# EasyEDA Pro project PR.eprj, schematic 新大符2.0 (continued)
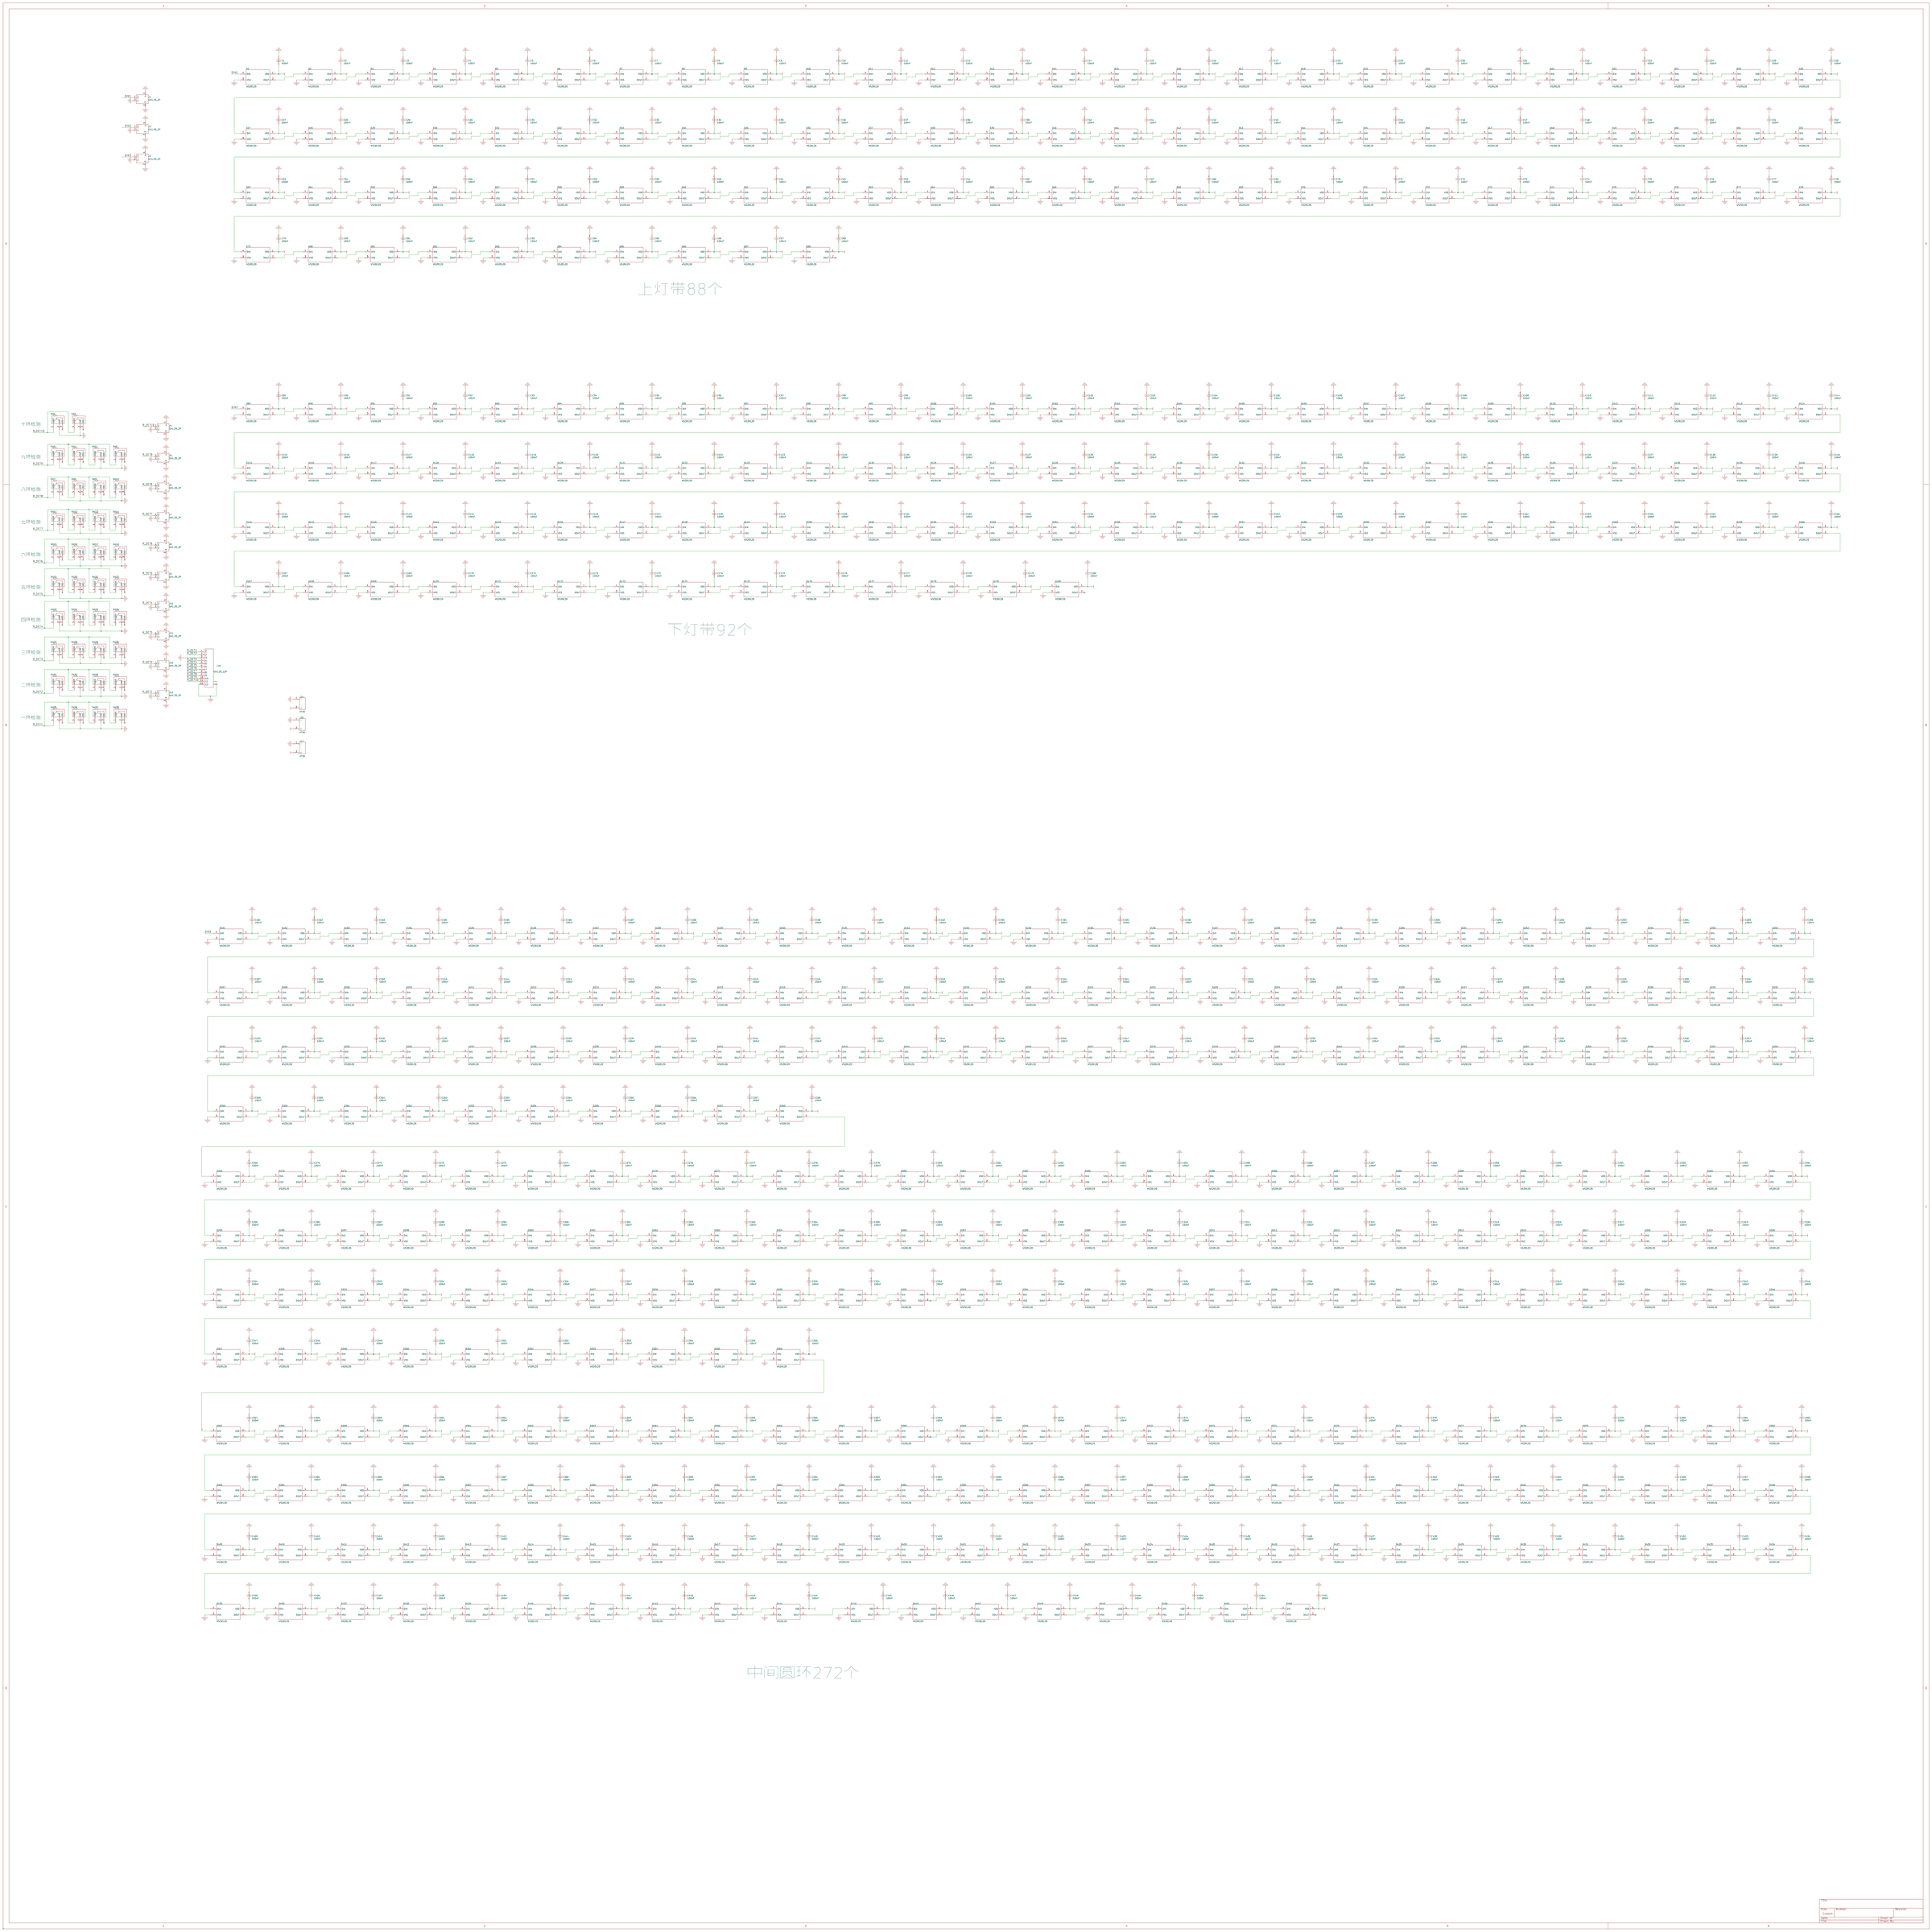
[diagram p0: schematic sheet]
## Parts (continued)
D187  *  [LED-SMD_4P-L5.0-W5.0-TL_WS2812B-B]
D188  *  [LED-SMD_4P-L5.0-W5.0-TL_WS2812B-B]
D189  *  [LED-SMD_4P-L5.0-W5.0-TL_WS2812B-B]
D190  *  [LED-SMD_4P-L5.0-W5.0-TL_WS2812B-B]
D191  *  [LED-SMD_4P-L5.0-W5.0-TL_WS2812B-B]
D192  *  [LED-SMD_4P-L5.0-W5.0-TL_WS2812B-B]
D193  *  [LED-SMD_4P-L5.0-W5.0-TL_WS2812B-B]
D194  *  [LED-SMD_4P-L5.0-W5.0-TL_WS2812B-B]
D195  *  [LED-SMD_4P-L5.0-W5.0-TL_WS2812B-B]
D196  *  [LED-SMD_4P-L5.0-W5.0-TL_WS2812B-B]
D197  *  [LED-SMD_4P-L5.0-W5.0-TL_WS2812B-B]
D198  *  [LED-SMD_4P-L5.0-W5.0-TL_WS2812B-B]
D199  *  [LED-SMD_4P-L5.0-W5.0-TL_WS2812B-B]
D200  *  [LED-SMD_4P-L5.0-W5.0-TL_WS2812B-B]
D201  *  [LED-SMD_4P-L5.0-W5.0-TL_WS2812B-B]
D202  *  [LED-SMD_4P-L5.0-W5.0-TL_WS2812B-B]
D203  *  [LED-SMD_4P-L5.0-W5.0-TL_WS2812B-B]
D204  *  [LED-SMD_4P-L5.0-W5.0-TL_WS2812B-B]
D205  *  [LED-SMD_4P-L5.0-W5.0-TL_WS2812B-B]
D206  *  [LED-SMD_4P-L5.0-W5.0-TL_WS2812B-B]
D207  *  [LED-SMD_4P-L5.0-W5.0-TL_WS2812B-B]
D208  *  [LED-SMD_4P-L5.0-W5.0-TL_WS2812B-B]
D209  *  [LED-SMD_4P-L5.0-W5.0-TL_WS2812B-B]
D210  *  [LED-SMD_4P-L5.0-W5.0-TL_WS2812B-B]
D211  *  [LED-SMD_4P-L5.0-W5.0-TL_WS2812B-B]
D212  *  [LED-SMD_4P-L5.0-W5.0-TL_WS2812B-B]
D213  *  [LED-SMD_4P-L5.0-W5.0-TL_WS2812B-B]
D214  *  [LED-SMD_4P-L5.0-W5.0-TL_WS2812B-B]
D215  *  [LED-SMD_4P-L5.0-W5.0-TL_WS2812B-B]
D216  *  [LED-SMD_4P-L5.0-W5.0-TL_WS2812B-B]
D217  *  [LED-SMD_4P-L5.0-W5.0-TL_WS2812B-B]
D218  *  [LED-SMD_4P-L5.0-W5.0-TL_WS2812B-B]
D219  *  [LED-SMD_4P-L5.0-W5.0-TL_WS2812B-B]
D220  *  [LED-SMD_4P-L5.0-W5.0-TL_WS2812B-B]
D221  *  [LED-SMD_4P-L5.0-W5.0-TL_WS2812B-B]
D222  *  [LED-SMD_4P-L5.0-W5.0-TL_WS2812B-B]
D223  *  [LED-SMD_4P-L5.0-W5.0-TL_WS2812B-B]
D224  *  [LED-SMD_4P-L5.0-W5.0-TL_WS2812B-B]
D225  *  [LED-SMD_4P-L5.0-W5.0-TL_WS2812B-B]
D226  *  [LED-SMD_4P-L5.0-W5.0-TL_WS2812B-B]
D227  *  [LED-SMD_4P-L5.0-W5.0-TL_WS2812B-B]
D228  *  [LED-SMD_4P-L5.0-W5.0-TL_WS2812B-B]
D229  *  [LED-SMD_4P-L5.0-W5.0-TL_WS2812B-B]
D230  *  [LED-SMD_4P-L5.0-W5.0-TL_WS2812B-B]
D231  *  [LED-SMD_4P-L5.0-W5.0-TL_WS2812B-B]
D232  *  [LED-SMD_4P-L5.0-W5.0-TL_WS2812B-B]
D233  *  [LED-SMD_4P-L5.0-W5.0-TL_WS2812B-B]
D234  *  [LED-SMD_4P-L5.0-W5.0-TL_WS2812B-B]
D235  *  [LED-SMD_4P-L5.0-W5.0-TL_WS2812B-B]
D236  *  [LED-SMD_4P-L5.0-W5.0-TL_WS2812B-B]
D237  *  [LED-SMD_4P-L5.0-W5.0-TL_WS2812B-B]
D238  *  [LED-SMD_4P-L5.0-W5.0-TL_WS2812B-B]
D239  *  [LED-SMD_4P-L5.0-W5.0-TL_WS2812B-B]
D240  *  [LED-SMD_4P-L5.0-W5.0-TL_WS2812B-B]
D241  *  [LED-SMD_4P-L5.0-W5.0-TL_WS2812B-B]
D242  *  [LED-SMD_4P-L5.0-W5.0-TL_WS2812B-B]
D243  *  [LED-SMD_4P-L5.0-W5.0-TL_WS2812B-B]
D244  *  [LED-SMD_4P-L5.0-W5.0-TL_WS2812B-B]
D245  *  [LED-SMD_4P-L5.0-W5.0-TL_WS2812B-B]
D246  *  [LED-SMD_4P-L5.0-W5.0-TL_WS2812B-B]
D247  *  [LED-SMD_4P-L5.0-W5.0-TL_WS2812B-B]
D248  *  [LED-SMD_4P-L5.0-W5.0-TL_WS2812B-B]
D249  *  [LED-SMD_4P-L5.0-W5.0-TL_WS2812B-B]
D250  *  [LED-SMD_4P-L5.0-W5.0-TL_WS2812B-B]
D251  *  [LED-SMD_4P-L5.0-W5.0-TL_WS2812B-B]
D252  *  [LED-SMD_4P-L5.0-W5.0-TL_WS2812B-B]
D253  *  [LED-SMD_4P-L5.0-W5.0-TL_WS2812B-B]
D254  *  [LED-SMD_4P-L5.0-W5.0-TL_WS2812B-B]
D255  *  [LED-SMD_4P-L5.0-W5.0-TL_WS2812B-B]
D256  *  [LED-SMD_4P-L5.0-W5.0-TL_WS2812B-B]
D257  *  [LED-SMD_4P-L5.0-W5.0-TL_WS2812B-B]
D258  *  [LED-SMD_4P-L5.0-W5.0-TL_WS2812B-B]
D259  *  [LED-SMD_4P-L5.0-W5.0-TL_WS2812B-B]
D260  *  [LED-SMD_4P-L5.0-W5.0-TL_WS2812B-B]
D261  *  [LED-SMD_4P-L5.0-W5.0-TL_WS2812B-B]
D262  *  [LED-SMD_4P-L5.0-W5.0-TL_WS2812B-B]
D263  *  [LED-SMD_4P-L5.0-W5.0-TL_WS2812B-B]
D264  *  [LED-SMD_4P-L5.0-W5.0-TL_WS2812B-B]
D265  *  [LED-SMD_4P-L5.0-W5.0-TL_WS2812B-B]
D266  *  [LED-SMD_4P-L5.0-W5.0-TL_WS2812B-B]
D267  *  [LED-SMD_4P-L5.0-W5.0-TL_WS2812B-B]
D268  *  [LED-SMD_4P-L5.0-W5.0-TL_WS2812B-B]
D269  *  [LED-SMD_4P-L5.0-W5.0-TL_WS2812B-B]
D270  *  [LED-SMD_4P-L5.0-W5.0-TL_WS2812B-B]
D271  *  [LED-SMD_4P-L5.0-W5.0-TL_WS2812B-B]
D272  *  [LED-SMD_4P-L5.0-W5.0-TL_WS2812B-B]
D273  *  [LED-SMD_4P-L5.0-W5.0-TL_WS2812B-B]
D274  *  [LED-SMD_4P-L5.0-W5.0-TL_WS2812B-B]
D275  *  [LED-SMD_4P-L5.0-W5.0-TL_WS2812B-B]
D276  *  [LED-SMD_4P-L5.0-W5.0-TL_WS2812B-B]
D277  *  [LED-SMD_4P-L5.0-W5.0-TL_WS2812B-B]
D278  *  [LED-SMD_4P-L5.0-W5.0-TL_WS2812B-B]
D279  *  [LED-SMD_4P-L5.0-W5.0-TL_WS2812B-B]
D280  *  [LED-SMD_4P-L5.0-W5.0-TL_WS2812B-B]
D281  *  [LED-SMD_4P-L5.0-W5.0-TL_WS2812B-B]
D282  *  [LED-SMD_4P-L5.0-W5.0-TL_WS2812B-B]
D283  *  [LED-SMD_4P-L5.0-W5.0-TL_WS2812B-B]
D284  *  [LED-SMD_4P-L5.0-W5.0-TL_WS2812B-B]
D285  *  [LED-SMD_4P-L5.0-W5.0-TL_WS2812B-B]
D286  *  [LED-SMD_4P-L5.0-W5.0-TL_WS2812B-B]
D287  *  [LED-SMD_4P-L5.0-W5.0-TL_WS2812B-B]
D288  *  [LED-SMD_4P-L5.0-W5.0-TL_WS2812B-B]
D289  *  [LED-SMD_4P-L5.0-W5.0-TL_WS2812B-B]
D290  *  [LED-SMD_4P-L5.0-W5.0-TL_WS2812B-B]
D291  *  [LED-SMD_4P-L5.0-W5.0-TL_WS2812B-B]
D292  *  [LED-SMD_4P-L5.0-W5.0-TL_WS2812B-B]
D293  *  [LED-SMD_4P-L5.0-W5.0-TL_WS2812B-B]
D294  *  [LED-SMD_4P-L5.0-W5.0-TL_WS2812B-B]
D295  *  [LED-SMD_4P-L5.0-W5.0-TL_WS2812B-B]
D296  *  [LED-SMD_4P-L5.0-W5.0-TL_WS2812B-B]
D297  *  [LED-SMD_4P-L5.0-W5.0-TL_WS2812B-B]
D298  *  [LED-SMD_4P-L5.0-W5.0-TL_WS2812B-B]
D299  *  [LED-SMD_4P-L5.0-W5.0-TL_WS2812B-B]
D300  *  [LED-SMD_4P-L5.0-W5.0-TL_WS2812B-B]
D301  *  [LED-SMD_4P-L5.0-W5.0-TL_WS2812B-B]
D302  *  [LED-SMD_4P-L5.0-W5.0-TL_WS2812B-B]
D303  *  [LED-SMD_4P-L5.0-W5.0-TL_WS2812B-B]
D304  *  [LED-SMD_4P-L5.0-W5.0-TL_WS2812B-B]
D305  *  [LED-SMD_4P-L5.0-W5.0-TL_WS2812B-B]
D306  *  [LED-SMD_4P-L5.0-W5.0-TL_WS2812B-B]
D307  *  [LED-SMD_4P-L5.0-W5.0-TL_WS2812B-B]
D308  *  [LED-SMD_4P-L5.0-W5.0-TL_WS2812B-B]
D309  *  [LED-SMD_4P-L5.0-W5.0-TL_WS2812B-B]
D310  *  [LED-SMD_4P-L5.0-W5.0-TL_WS2812B-B]
D311  *  [LED-SMD_4P-L5.0-W5.0-TL_WS2812B-B]
D312  *  [LED-SMD_4P-L5.0-W5.0-TL_WS2812B-B]
D313  *  [LED-SMD_4P-L5.0-W5.0-TL_WS2812B-B]
D314  *  [LED-SMD_4P-L5.0-W5.0-TL_WS2812B-B]
D315  *  [LED-SMD_4P-L5.0-W5.0-TL_WS2812B-B]
D316  *  [LED-SMD_4P-L5.0-W5.0-TL_WS2812B-B]
D317  *  [LED-SMD_4P-L5.0-W5.0-TL_WS2812B-B]
D318  *  [LED-SMD_4P-L5.0-W5.0-TL_WS2812B-B]
D319  *  [LED-SMD_4P-L5.0-W5.0-TL_WS2812B-B]
D320  *  [LED-SMD_4P-L5.0-W5.0-TL_WS2812B-B]
D321  *  [LED-SMD_4P-L5.0-W5.0-TL_WS2812B-B]
D322  *  [LED-SMD_4P-L5.0-W5.0-TL_WS2812B-B]
D323  *  [LED-SMD_4P-L5.0-W5.0-TL_WS2812B-B]
D324  *  [LED-SMD_4P-L5.0-W5.0-TL_WS2812B-B]
D325  *  [LED-SMD_4P-L5.0-W5.0-TL_WS2812B-B]
D326  *  [LED-SMD_4P-L5.0-W5.0-TL_WS2812B-B]
D327  *  [LED-SMD_4P-L5.0-W5.0-TL_WS2812B-B]
D328  *  [LED-SMD_4P-L5.0-W5.0-TL_WS2812B-B]
D329  *  [LED-SMD_4P-L5.0-W5.0-TL_WS2812B-B]
D330  *  [LED-SMD_4P-L5.0-W5.0-TL_WS2812B-B]
D331  *  [LED-SMD_4P-L5.0-W5.0-TL_WS2812B-B]
D332  *  [LED-SMD_4P-L5.0-W5.0-TL_WS2812B-B]
D333  *  [LED-SMD_4P-L5.0-W5.0-TL_WS2812B-B]
D334  *  [LED-SMD_4P-L5.0-W5.0-TL_WS2812B-B]
D335  *  [LED-SMD_4P-L5.0-W5.0-TL_WS2812B-B]
D336  *  [LED-SMD_4P-L5.0-W5.0-TL_WS2812B-B]
D337  *  [LED-SMD_4P-L5.0-W5.0-TL_WS2812B-B]
D338  *  [LED-SMD_4P-L5.0-W5.0-TL_WS2812B-B]
D339  *  [LED-SMD_4P-L5.0-W5.0-TL_WS2812B-B]
D340  *  [LED-SMD_4P-L5.0-W5.0-TL_WS2812B-B]
D341  *  [LED-SMD_4P-L5.0-W5.0-TL_WS2812B-B]
D342  *  [LED-SMD_4P-L5.0-W5.0-TL_WS2812B-B]
D343  *  [LED-SMD_4P-L5.0-W5.0-TL_WS2812B-B]
D344  *  [LED-SMD_4P-L5.0-W5.0-TL_WS2812B-B]
D345  *  [LED-SMD_4P-L5.0-W5.0-TL_WS2812B-B]
D346  *  [LED-SMD_4P-L5.0-W5.0-TL_WS2812B-B]
D347  *  [LED-SMD_4P-L5.0-W5.0-TL_WS2812B-B]
D348  *  [LED-SMD_4P-L5.0-W5.0-TL_WS2812B-B]
D349  *  [LED-SMD_4P-L5.0-W5.0-TL_WS2812B-B]
D350  *  [LED-SMD_4P-L5.0-W5.0-TL_WS2812B-B]
D351  *  [LED-SMD_4P-L5.0-W5.0-TL_WS2812B-B]
D352  *  [LED-SMD_4P-L5.0-W5.0-TL_WS2812B-B]
D353  *  [LED-SMD_4P-L5.0-W5.0-TL_WS2812B-B]
D354  *  [LED-SMD_4P-L5.0-W5.0-TL_WS2812B-B]
D355  *  [LED-SMD_4P-L5.0-W5.0-TL_WS2812B-B]
D356  *  [LED-SMD_4P-L5.0-W5.0-TL_WS2812B-B]
D357  *  [LED-SMD_4P-L5.0-W5.0-TL_WS2812B-B]
D358  *  [LED-SMD_4P-L5.0-W5.0-TL_WS2812B-B]
D359  *  [LED-SMD_4P-L5.0-W5.0-TL_WS2812B-B]
D360  *  [LED-SMD_4P-L5.0-W5.0-TL_WS2812B-B]
D361  *  [LED-SMD_4P-L5.0-W5.0-TL_WS2812B-B]
D362  *  [LED-SMD_4P-L5.0-W5.0-TL_WS2812B-B]
D363  *  [LED-SMD_4P-L5.0-W5.0-TL_WS2812B-B]
D364  *  [LED-SMD_4P-L5.0-W5.0-TL_WS2812B-B]
D365  *  [LED-SMD_4P-L5.0-W5.0-TL_WS2812B-B]
D366  *  [LED-SMD_4P-L5.0-W5.0-TL_WS2812B-B]
D367  *  [LED-SMD_4P-L5.0-W5.0-TL_WS2812B-B]
D368  *  [LED-SMD_4P-L5.0-W5.0-TL_WS2812B-B]
D369  *  [LED-SMD_4P-L5.0-W5.0-TL_WS2812B-B]
D370  *  [LED-SMD_4P-L5.0-W5.0-TL_WS2812B-B]
D371  *  [LED-SMD_4P-L5.0-W5.0-TL_WS2812B-B]
D372  *  [LED-SMD_4P-L5.0-W5.0-TL_WS2812B-B]
D373  *  [LED-SMD_4P-L5.0-W5.0-TL_WS2812B-B]
D374  *  [LED-SMD_4P-L5.0-W5.0-TL_WS2812B-B]
D375  *  [LED-SMD_4P-L5.0-W5.0-TL_WS2812B-B]
D376  *  [LED-SMD_4P-L5.0-W5.0-TL_WS2812B-B]
D377  *  [LED-SMD_4P-L5.0-W5.0-TL_WS2812B-B]
D378  *  [LED-SMD_4P-L5.0-W5.0-TL_WS2812B-B]
D379  *  [LED-SMD_4P-L5.0-W5.0-TL_WS2812B-B]
D380  *  [LED-SMD_4P-L5.0-W5.0-TL_WS2812B-B]
D381  *  [LED-SMD_4P-L5.0-W5.0-TL_WS2812B-B]
D382  *  [LED-SMD_4P-L5.0-W5.0-TL_WS2812B-B]
D383  *  [LED-SMD_4P-L5.0-W5.0-TL_WS2812B-B]
D384  *  [LED-SMD_4P-L5.0-W5.0-TL_WS2812B-B]
D385  *  [LED-SMD_4P-L5.0-W5.0-TL_WS2812B-B]
D386  *  [LED-SMD_4P-L5.0-W5.0-TL_WS2812B-B]
D387  *  [LED-SMD_4P-L5.0-W5.0-TL_WS2812B-B]
D388  *  [LED-SMD_4P-L5.0-W5.0-TL_WS2812B-B]
D389  *  [LED-SMD_4P-L5.0-W5.0-TL_WS2812B-B]
D390  *  [LED-SMD_4P-L5.0-W5.0-TL_WS2812B-B]
D391  *  [LED-SMD_4P-L5.0-W5.0-TL_WS2812B-B]
D392  *  [LED-SMD_4P-L5.0-W5.0-TL_WS2812B-B]
D393  *  [LED-SMD_4P-L5.0-W5.0-TL_WS2812B-B]
D394  *  [LED-SMD_4P-L5.0-W5.0-TL_WS2812B-B]
D395  *  [LED-SMD_4P-L5.0-W5.0-TL_WS2812B-B]
D396  *  [LED-SMD_4P-L5.0-W5.0-TL_WS2812B-B]
D397  *  [LED-SMD_4P-L5.0-W5.0-TL_WS2812B-B]
D398  *  [LED-SMD_4P-L5.0-W5.0-TL_WS2812B-B]
D399  *  [LED-SMD_4P-L5.0-W5.0-TL_WS2812B-B]
D400  *  [LED-SMD_4P-L5.0-W5.0-TL_WS2812B-B]
D401  *  [LED-SMD_4P-L5.0-W5.0-TL_WS2812B-B]
D402  *  [LED-SMD_4P-L5.0-W5.0-TL_WS2812B-B]
D403  *  [LED-SMD_4P-L5.0-W5.0-TL_WS2812B-B]
D404  *  [LED-SMD_4P-L5.0-W5.0-TL_WS2812B-B]
D405  *  [LED-SMD_4P-L5.0-W5.0-TL_WS2812B-B]
D406  *  [LED-SMD_4P-L5.0-W5.0-TL_WS2812B-B]
D407  *  [LED-SMD_4P-L5.0-W5.0-TL_WS2812B-B]
D408  *  [LED-SMD_4P-L5.0-W5.0-TL_WS2812B-B]
D409  *  [LED-SMD_4P-L5.0-W5.0-TL_WS2812B-B]
D410  *  [LED-SMD_4P-L5.0-W5.0-TL_WS2812B-B]
D411  *  [LED-SMD_4P-L5.0-W5.0-TL_WS2812B-B]
D412  *  [LED-SMD_4P-L5.0-W5.0-TL_WS2812B-B]
D413  *  [LED-SMD_4P-L5.0-W5.0-TL_WS2812B-B]
D414  *  [LED-SMD_4P-L5.0-W5.0-TL_WS2812B-B]
D415  *  [LED-SMD_4P-L5.0-W5.0-TL_WS2812B-B]
D416  *  [LED-SMD_4P-L5.0-W5.0-TL_WS2812B-B]
D417  *  [LED-SMD_4P-L5.0-W5.0-TL_WS2812B-B]
D418  *  [LED-SMD_4P-L5.0-W5.0-TL_WS2812B-B]
D419  *  [LED-SMD_4P-L5.0-W5.0-TL_WS2812B-B]
D420  *  [LED-SMD_4P-L5.0-W5.0-TL_WS2812B-B]
D421  *  [LED-SMD_4P-L5.0-W5.0-TL_WS2812B-B]
D422  *  [LED-SMD_4P-L5.0-W5.0-TL_WS2812B-B]
D423  *  [LED-SMD_4P-L5.0-W5.0-TL_WS2812B-B]
D424  *  [LED-SMD_4P-L5.0-W5.0-TL_WS2812B-B]
D425  *  [LED-SMD_4P-L5.0-W5.0-TL_WS2812B-B]
D426  *  [LED-SMD_4P-L5.0-W5.0-TL_WS2812B-B]
D427  *  [LED-SMD_4P-L5.0-W5.0-TL_WS2812B-B]
D428  *  [LED-SMD_4P-L5.0-W5.0-TL_WS2812B-B]
D429  *  [LED-SMD_4P-L5.0-W5.0-TL_WS2812B-B]
D430  *  [LED-SMD_4P-L5.0-W5.0-TL_WS2812B-B]
D431  *  [LED-SMD_4P-L5.0-W5.0-TL_WS2812B-B]
D432  *  [LED-SMD_4P-L5.0-W5.0-TL_WS2812B-B]
D433  *  [LED-SMD_4P-L5.0-W5.0-TL_WS2812B-B]
D434  *  [LED-SMD_4P-L5.0-W5.0-TL_WS2812B-B]
D435  *  [LED-SMD_4P-L5.0-W5.0-TL_WS2812B-B]
D436  *  [LED-SMD_4P-L5.0-W5.0-TL_WS2812B-B]
D437  *  [LED-SMD_4P-L5.0-W5.0-TL_WS2812B-B]
D438  *  [LED-SMD_4P-L5.0-W5.0-TL_WS2812B-B]
D439  *  [LED-SMD_4P-L5.0-W5.0-TL_WS2812B-B]
D440  *  [LED-SMD_4P-L5.0-W5.0-TL_WS2812B-B]
D441  *  [LED-SMD_4P-L5.0-W5.0-TL_WS2812B-B]
D442  *  [LED-SMD_4P-L5.0-W5.0-TL_WS2812B-B]
D443  *  [LED-SMD_4P-L5.0-W5.0-TL_WS2812B-B]
D444  *  [LED-SMD_4P-L5.0-W5.0-TL_WS2812B-B]
D445  *  [LED-SMD_4P-L5.0-W5.0-TL_WS2812B-B]
D446  *  [LED-SMD_4P-L5.0-W5.0-TL_WS2812B-B]
D447  *  [LED-SMD_4P-L5.0-W5.0-TL_WS2812B-B]
D448  *  [LED-SMD_4P-L5.0-W5.0-TL_WS2812B-B]
D449  *  [LED-SMD_4P-L5.0-W5.0-TL_WS2812B-B]
D450  *  [LED-SMD_4P-L5.0-W5.0-TL_WS2812B-B]
D451  *  [LED-SMD_4P-L5.0-W5.0-TL_WS2812B-B]
D452  *  [LED-SMD_4P-L5.0-W5.0-TL_WS2812B-B]
J1  GH1.25_2P  [GH1.25-LS-2P]
J2  GH1.25_2P  [GH1.25-LS-2P]
J3  GH1.25_2P  [GH1.25-LS-2P]
J4  GH1.25_2P  [GH1.25-LS-2P]
J5  GH1.25_2P  [GH1.25-LS-2P]
J6  GH1.25_2P  [GH1.25-LS-2P]
J7  GH1.25_2P  [GH1.25-LS-2P]
J8  GH1.25_2P  [GH1.25-LS-2P]
J9  GH1.25_2P  [GH1.25-LS-2P]
J10  GH1.25_2P  [GH1.25-LS-2P]
J11  GH1.25_2P  [GH1.25-LS-2P]
J12  GH1.25_2P  [GH1.25-LS-2P]
J13  GH1.25_2P  [GH1.25-LS-2P]
J14  XT30  [XT30M]
J15  XT30  [XT30M]
J17  XT30  [XT30M]
J18  GH1.25_12P  [GH1.25_12P]
SW1  Microswitch  [SW-TH_MICROSWITCH]
SW2  Microswitch  [SW-TH_MICROSWITCH]
SW3  Microswitch  [SW-TH_MICROSWITCH]
SW4  Microswitch  [SW-TH_MICROSWITCH]
SW5  Microswitch  [SW-TH_MICROSWITCH]
SW6  Microswitch  [SW-TH_MICROSWITCH]
SW7  Microswitch  [SW-TH_MICROSWITCH]
SW8  Microswitch  [SW-TH_MICROSWITCH]
SW9  Microswitch  [SW-TH_MICROSWITCH]
SW10  Microswitch  [SW-TH_MICROSWITCH]
SW11  Microswitch  [SW-TH_MICROSWITCH]
SW12  Microswitch  [SW-TH_MICROSWITCH]
SW13  Microswitch  [SW-TH_MICROSWITCH]
SW14  Microswitch  [SW-TH_MICROSWITCH]
SW15  Microswitch  [SW-TH_MICROSWITCH]
SW16  Microswitch  [SW-TH_MICROSWITCH]
SW17  Microswitch  [SW-TH_MICROSWITCH]
SW18  Microswitch  [SW-TH_MICROSWITCH]
SW19  Microswitch  [SW-TH_MICROSWITCH]
SW20  Microswitch  [SW-TH_MICROSWITCH]
SW21  Microswitch  [SW-TH_MICROSWITCH]
SW22  Microswitch  [SW-TH_MICROSWITCH]
SW23  Microswitch  [SW-TH_MICROSWITCH]
SW24  Microswitch  [SW-TH_MICROSWITCH]
SW25  Microswitch  [SW-TH_MICROSWITCH]
SW26  Microswitch  [SW-TH_MICROSWITCH]
SW27  Microswitch  [SW-TH_MICROSWITCH]
SW28  Microswitch  [SW-TH_MICROSWITCH]
SW29  Microswitch  [SW-TH_MICROSWITCH]
SW30  Microswitch  [SW-TH_MICROSWITCH]
SW31  Microswitch  [SW-TH_MICROSWITCH]
SW32  Microswitch  [SW-TH_MICROSWITCH]
SW33  Microswitch  [SW-TH_MICROSWITCH]
SW34  Microswitch  [SW-TH_MICROSWITCH]
SW35  Microswitch  [SW-TH_MICROSWITCH]
SW36  Microswitch  [SW-TH_MICROSWITCH]
SW37  Microswitch  [SW-TH_MICROSWITCH]
SW38  Microswitch  [SW-TH_MICROSWITCH]

## Library data of the parts
C1-C452 = 100nF: Capacitor; Supplier: LCSC; Manufacturer: SEIKO; Manufacturer Part: XH414HG-IV01E; Supplier Part: C38065; Library Name: LIN_Library
D1-D452 = WS2812B: Intelligent control LED integrated light source; Availability: Unavailable; Price: None; MP: WS2812B-B; Library Name: LIN_Library
J1-J13 = GH1.25_2P: Connector; Origin Footprint 2: GH1.25-WS-2P; Library Name: LIN_Library
J14 J15 J17 = XT30: 电池接头连接器; Origin Footprint 2: XT30F; Library Name: LIN_Library
J18 = GH1.25_12P: LCSC Part Name: 立式贴片 镀锡12P; Supplier Part: C272988; Manufacturer: CJT(长江连接器); Manufacturer Part: A1257WV-S-12P; Supplier Footprint: SMD,P=1.25mm; JLCPCB Part Class: Extended Part; Datasheet: https://atta.szlcsc.com/upload/public/pdf/source/20181008/C272988_212BDFCFF0BBDA51EDF8FB81D3CF3687.pdf; Supplier: LCSC; Reference Series: GH; Pitch: 1.25mm; Pins Structure: 1x12P; Number of Rows: 1; Number of PINs Per Row: 12; Contact Material: 黄铜; Origin Footprint 2: CONN-SMD_A1257WV-S-12P; Design Item ID: A1257WV-S-12P
SW1-SW38 = Microswitch: 淘宝risym旗舰店（鼠标开关带弯柄1A 125V）; LCSC Part Name: SS-5GL111; Supplier Part: C5123513; Manufacturer: OMRON(欧姆龙); Manufacturer Part: SS-5GL111; Supplier Footprint: 插件; Datasheet: https://atta.szlcsc.com/upload/public/pdf/source/20220815/0B025EB52777D6B6F4567A2D38F1A354.pdf; Supplier: LCSC; Library Name: LIN_Library

## Nets
GND: C1.2 C2.2 C3.2 C4.2 C5.2 C6.2 C7.2 C8.2 C9.2 C10.2 C11.2 C12.2 C13.2 C14.2 C15.2 C16.2 C17.2 C18.2 C19.2 C20.2 C21.2 C22.2 C23.2 C24.2 C25.2 C26.2 C27.2 C28.2 C29.2 C30.2 C31.2 C32.2 C33.2 C34.2 C35.2 C36.2 C37.2 C38.2 C39.2 C40.2 C41.2 C42.2 C43.2 C44.2 C45.2 C46.2 C47.2 C48.2 C49.2 C50.2 C51.2 C52.2 C53.2 C54.2 C55.2 C56.2 C57.2 C58.2 C59.2 C60.2 C61.2 C62.2 C63.2 C64.2 C65.2 C66.2 C67.2 C68.2 C69.2 C70.2 C71.2 C72.2 C73.2 C74.2 C75.2 C76.2 C77.2 C78.2 C79.2 C80.2 C81.2 C82.2 C83.2 C84.2 C85.2 C86.2 C87.2 C88.2 C89.2 C90.2 C91.2 C92.2 C93.2 C94.2 C95.2 C96.2 C97.2 C98.2 C99.2 C100.2 C101.2 C102.2 C103.2 C104.2 C105.2 C106.2 C107.2 C108.2 C109.2 C110.2 C111.2 C112.2 C113.2 C114.2 C115.2 C116.2 C117.2 C118.2 C119.2 C120.2 C121.2 C122.2 C123.2 C124.2 C125.2 C126.2 C127.2 C128.2 C129.2 C130.2 C131.2 C132.2 C133.2 C134.2 C135.2 C136.2 C137.2 C138.2 C139.2 C140.2 C141.2 C142.2 C143.2 C144.2 C145.2 C146.2 C147.2 C148.2 C149.2 C150.2 C151.2 C152.2 C153.2 C154.2 C155.2 C156.2 C157.2 C158.2 C159.2 C160.2 C161.2 C162.2 C163.2 C164.2 C165.2 C166.2 C167.2 C168.2 C169.2 C170.2 C171.2 C172.2 C173.2 C174.2 C175.2 C176.2 C177.2 C178.2 C179.2 C180.2 C181.2 C182.2 C183.2 C184.2 C185.2 C186.2 C187.2 C188.2 C189.2 C190.2 C191.2 C192.2 C193.2 C194.2 C195.2 C196.2 C197.2 C198.2 C199.2 C200.2 C201.2 C202.2 C203.2 C204.2 C205.2 C206.2 C207.2 C208.2 C209.2 C210.2 C211.2 C212.2 C213.2 C214.2 C215.2 C216.2 C217.2 C218.2 C219.2 C220.2 C221.2 C222.2 C223.2 C224.2 C225.2 C226.2 C227.2 C228.2 C229.2 C230.2 C231.2 C232.2 C233.2 C234.2 C235.2 C236.2 C237.2 C238.2 C239.2 C240.2 C241.2 C242.2 C243.2 C244.2 C245.2 C246.2 C247.2 C248.2 C249.2 C250.2 C251.2 C252.2 C253.2 C254.2 C255.2 C256.2 C257.2 C258.2 C259.2 C260.2 C261.2 C262.2 C263.2 C264.2 C265.2 C266.2 C267.2 C268.2 C269.2 C270.2 C271.2 C272.2 C273.2 C274.2 C275.2 C276.2 C277.2 C278.2 C279.2 C280.2 C281.2 C282.2 C283.2 C284.2 C285.2 C286.2 C287.2 C288.2 C289.2 C290.2 C291.2 C292.2 C293.2 C294.2 C295.2 C296.2 C297.2 C298.2 C299.2 C300.2 C301.2 C302.2 C303.2 C304.2 C305.2 C306.2 C307.2 C308.2 C309.2 C310.2 C311.2 C312.2 C313.2 C314.2 C315.2 C316.2 C317.2 C318.2 C319.2 C320.2 C321.2 C322.2 C323.2 C324.2 C325.2 C326.2 C327.2 C328.2 C329.2 C330.2 C331.2 C332.2 C333.2 C334.2 C335.2 C336.2 C337.2 C338.2 C339.2 C340.2 C341.2 C342.2 C343.2 C344.2 C345.2 C346.2 C347.2 C348.2 C349.2 C350.2 C351.2 C352.2 C353.2 C354.2 C355.2 C356.2 C357.2 C358.2 C359.2 C360.2 C361.2 C362.2 C363.2 C364.2 C365.2 C366.2 C367.2 C368.2 C369.2 C370.2 C371.2 C372.2 C373.2 C374.2 C375.2 C376.2 C377.2 C378.2 C379.2 C380.2 C381.2 C382.2 C383.2 C384.2 C385.2 C386.2 C387.2 C388.2 C389.2 C390.2 C391.2 C392.2 C393.2 C394.2 C395.2 C396.2 C397.2 C398.2 C399.2 C400.2 C401.2 C402.2 C403.2 C404.2 C405.2 C406.2 C407.2 C408.2 C409.2 C410.2 C411.2 C412.2 C413.2 C414.2 C415.2 C416.2 C417.2 C418.2 C419.2 C420.2 C421.2 C422.2 C423.2 C424.2 C425.2 C426.2 C427.2 C428.2 C429.2 C430.2 C431.2 C432.2 C433.2 C434.2 C435.2 C436.2 C437.2 C438.2 C439.2 C440.2 C441.2 C442.2 C443.2 C444.2 C445.2 C446.2 C447.2 C448.2 C449.2 C450.2 C451.2 C452.2 D1.3(VSS) D2.3(VSS) D3.3(VSS) D4.3(VSS) D5.3(VSS) D6.3(VSS) D7.3(VSS) D8.3(VSS) D9.3(VSS) D10.3(VSS) D11.3(VSS) D12.3(VSS) D13.3(VSS) D14.3(VSS) D15.3(VSS) D16.3(VSS) D17.3(VSS) D18.3(VSS) D19.3(VSS) D20.3(VSS) D21.3(VSS) D22.3(VSS) D23.3(VSS) D24.3(VSS) D25.3(VSS) D26.3(VSS) D27.3(VSS) D28.3(VSS) D29.3(VSS) D30.3(VSS) D31.3(VSS) D32.3(VSS) D33.3(VSS) D34.3(VSS) D35.3(VSS) D36.3(VSS) D37.3(VSS) D38.3(VSS) D39.3(VSS) D40.3(VSS) D41.3(VSS) D42.3(VSS) D43.3(VSS) D44.3(VSS) D45.3(VSS) D46.3(VSS) D47.3(VSS) D48.3(VSS) D49.3(VSS) D50.3(VSS) D51.3(VSS) D52.3(VSS) D53.3(VSS) D54.3(VSS) D55.3(VSS) D56.3(VSS) D57.3(VSS) D58.3(VSS) D59.3(VSS) D60.3(VSS) D61.3(VSS) D62.3(VSS) D63.3(VSS) D64.3(VSS) D65.3(VSS) D66.3(VSS) D67.3(VSS) D68.3(VSS) D69.3(VSS) D70.3(VSS) D71.3(VSS) D72.3(VSS) D73.3(VSS) D74.3(VSS) D75.3(VSS) D76.3(VSS) D77.3(VSS) D78.3(VSS) D79.3(VSS) D80.3(VSS) D81.3(VSS) D82.3(VSS) D83.3(VSS) D84.3(VSS) D85.3(VSS) D86.3(VSS) D87.3(VSS) D88.3(VSS) D89.3(VSS) D90.3(VSS) D91.3(VSS) D92.3(VSS) D93.3(VSS) D94.3(VSS) D95.3(VSS) D96.3(VSS) D97.3(VSS) D98.3(VSS) D99.3(VSS) D100.3(VSS) D101.3(VSS) D102.3(VSS) D103.3(VSS) D104.3(VSS) D105.3(VSS) D106.3(VSS) D107.3(VSS) D108.3(VSS) D109.3(VSS) D110.3(VSS) D111.3(VSS) D112.3(VSS) D113.3(VSS) D114.3(VSS) D115.3(VSS) D116.3(VSS) D117.3(VSS) D118.3(VSS) D119.3(VSS) D120.3(VSS) D121.3(VSS) D122.3(VSS) D123.3(VSS) D124.3(VSS) D125.3(VSS) D126.3(VSS) D127.3(VSS) D128.3(VSS) D129.3(VSS) D130.3(VSS) D131.3(VSS) D132.3(VSS) D133.3(VSS) D134.3(VSS) D135.3(VSS) D136.3(VSS) D137.3(VSS) D138.3(VSS) D139.3(VSS) D140.3(VSS) D141.3(VSS) D142.3(VSS) D143.3(VSS) D144.3(VSS) D145.3(VSS) D146.3(VSS) D147.3(VSS) D148.3(VSS) D149.3(VSS) D150.3(VSS) D151.3(VSS) D152.3(VSS) D153.3(VSS) D154.3(VSS) D155.3(VSS) D156.3(VSS) D157.3(VSS) D158.3(VSS) D159.3(VSS) D160.3(VSS) D161.3(VSS) D162.3(VSS) D163.3(VSS) D164.3(VSS) D165.3(VSS) D166.3(VSS) D167.3(VSS) D168.3(VSS) D169.3(VSS) D170.3(VSS) D171.3(VSS) D172.3(VSS) D173.3(VSS) D174.3(VSS) D175.3(VSS) D176.3(VSS) D177.3(VSS) D178.3(VSS) D179.3(VSS) D180.3(VSS) D181.3(VSS) D182.3(VSS) D183.3(VSS) D184.3(VSS) D185.3(VSS) D186.3(VSS) D187.3(VSS) D188.3(VSS) D189.3(VSS) D190.3(VSS) D191.3(VSS) D192.3(VSS) D193.3(VSS) D194.3(VSS) D195.3(VSS) D196.3(VSS) D197.3(VSS) D198.3(VSS) D199.3(VSS) D200.3(VSS) D201.3(VSS) D202.3(VSS) D203.3(VSS) D204.3(VSS) D205.3(VSS) D206.3(VSS) D207.3(VSS) D208.3(VSS) D209.3(VSS) D210.3(VSS) D211.3(VSS) D212.3(VSS) D213.3(VSS) D214.3(VSS) D215.3(VSS) D216.3(VSS) D217.3(VSS) D218.3(VSS) D219.3(VSS) D220.3(VSS) D221.3(VSS) D222.3(VSS) D223.3(VSS) D224.3(VSS) D225.3(VSS) D226.3(VSS) D227.3(VSS) D228.3(VSS) D229.3(VSS) D230.3(VSS) D231.3(VSS) D232.3(VSS) D233.3(VSS) D234.3(VSS) D235.3(VSS) D236.3(VSS) D237.3(VSS) D238.3(VSS) D239.3(VSS) D240.3(VSS) D241.3(VSS) D242.3(VSS) D243.3(VSS) D244.3(VSS) D245.3(VSS) D246.3(VSS) D247.3(VSS) D248.3(VSS) D249.3(VSS) D250.3(VSS) D251.3(VSS) D252.3(VSS) D253.3(VSS) D254.3(VSS) D255.3(VSS) D256.3(VSS) D257.3(VSS) D258.3(VSS) D259.3(VSS) D260.3(VSS) D261.3(VSS) D262.3(VSS) D263.3(VSS) D264.3(VSS) D265.3(VSS) D266.3(VSS) D267.3(VSS) D268.3(VSS) D269.3(VSS) D270.3(VSS) D271.3(VSS) D272.3(VSS) D273.3(VSS) D274.3(VSS) D275.3(VSS) D276.3(VSS) D277.3(VSS) D278.3(VSS) D279.3(VSS) D280.3(VSS) D281.3(VSS) D282.3(VSS) D283.3(VSS) D284.3(VSS) D285.3(VSS) D286.3(VSS) D287.3(VSS) D288.3(VSS) D289.3(VSS) D290.3(VSS) D291.3(VSS) D292.3(VSS) D293.3(VSS) D294.3(VSS) D295.3(VSS) D296.3(VSS) D297.3(VSS) D298.3(VSS) D299.3(VSS) D300.3(VSS) D301.3(VSS) D302.3(VSS) D303.3(VSS) D304.3(VSS) D305.3(VSS) D306.3(VSS) D307.3(VSS) D308.3(VSS) D309.3(VSS) D310.3(VSS) D311.3(VSS) D312.3(VSS) D313.3(VSS) D314.3(VSS) D315.3(VSS) D316.3(VSS) D317.3(VSS) D318.3(VSS) D319.3(VSS) D320.3(VSS) D321.3(VSS) D322.3(VSS) D323.3(VSS) D324.3(VSS) D325.3(VSS) D326.3(VSS) D327.3(VSS) D328.3(VSS) D329.3(VSS) D330.3(VSS) D331.3(VSS) D332.3(VSS) D333.3(VSS) D334.3(VSS) D335.3(VSS) D336.3(VSS) D337.3(VSS) D338.3(VSS) D339.3(VSS) D340.3(VSS) D341.3(VSS) D342.3(VSS) D343.3(VSS) D344.3(VSS) D345.3(VSS) D346.3(VSS) D347.3(VSS) D348.3(VSS) D349.3(VSS) D350.3(VSS) D351.3(VSS) D352.3(VSS) D353.3(VSS) D354.3(VSS) D355.3(VSS) D356.3(VSS) D357.3(VSS) D358.3(VSS) D359.3(VSS) D360.3(VSS) D361.3(VSS) D362.3(VSS) D363.3(VSS) D364.3(VSS) D365.3(VSS) D366.3(VSS) D367.3(VSS) D368.3(VSS) D369.3(VSS) D370.3(VSS) D371.3(VSS) D372.3(VSS) D373.3(VSS) D374.3(VSS) D375.3(VSS) D376.3(VSS) D377.3(VSS) D378.3(VSS) D379.3(VSS) D380.3(VSS) D381.3(VSS) D382.3(VSS) D383.3(VSS) D384.3(VSS) D385.3(VSS) D386.3(VSS) D387.3(VSS) D388.3(VSS) D389.3(VSS) D390.3(VSS) D391.3(VSS) D392.3(VSS) D393.3(VSS) D394.3(VSS) D395.3(VSS) D396.3(VSS) D397.3(VSS) D398.3(VSS) D399.3(VSS) D400.3(VSS) D401.3(VSS) D402.3(VSS) D403.3(VSS) D404.3(VSS) D405.3(VSS) D406.3(VSS) D407.3(VSS) D408.3(VSS) D409.3(VSS) D410.3(VSS) D411.3(VSS) D412.3(VSS) D413.3(VSS) D414.3(VSS) D415.3(VSS) D416.3(VSS) D417.3(VSS) D418.3(VSS) D419.3(VSS) D420.3(VSS) D421.3(VSS) D422.3(VSS) D423.3(VSS) D424.3(VSS) D425.3(VSS) D426.3(VSS) D427.3(VSS) D428.3(VSS) D429.3(VSS) D430.3(VSS) D431.3(VSS) D432.3(VSS) D433.3(VSS) D434.3(VSS) D435.3(VSS) D436.3(VSS) D437.3(VSS) D438.3(VSS) D439.3(VSS) D440.3(VSS) D441.3(VSS) D442.3(VSS) D443.3(VSS) D444.3(VSS) D445.3(VSS) D446.3(VSS) D447.3(VSS) D448.3(VSS) D449.3(VSS) D450.3(VSS) D451.3(VSS) D452.3(VSS) J1.2 J1.3 J1.4 J2.2 J2.3 J2.4 J3.2 J3.3 J3.4 J4.2 J4.3 J4.4 J5.2 J5.3 J5.4 J6.2 J6.3 J6.4 J7.2 J7.3 J7.4 J8.2 J8.3 J8.4 J9.2 J9.3 J9.4 J10.2 J10.3 J10.4 J11.2 J11.3 J11.4 J12.2 J12.3 J12.4 J13.2 J13.3 J13.4 J14.1(-) J15.1(-) J17.1(-) J18.3 J18.12 J18.14 J18.15 SW1.2(NO) SW2.2(NO) SW3.2(NO) SW4.2(NO) SW5.2(NO) SW6.2(NO) SW7.2(NO) SW8.2(NO) SW9.2(NO) SW10.2(NO) SW11.2(NO) SW12.2(NO) SW13.2(NO) SW14.2(NO) SW15.2(NO) SW16.2(NO) SW17.2(NO) SW18.2(NO) SW19.2(NO) SW20.2(NO) SW21.2(NO) SW22.2(NO) SW23.2(NO) SW24.2(NO) SW25.2(NO) SW26.2(NO) SW27.2(NO) SW28.2(NO) SW29.2(NO) SW30.2(NO) SW31.2(NO) SW32.2(NO) SW33.2(NO) SW34.2(NO) SW35.2(NO) SW36.2(NO) SW37.2(NO) SW38.2(NO)
